# EasyEDA Pro project 立创·天猛星MSPM0G3507开发板.eprj, schematic Schematic

## Sheets
1 core: Board Name: V1.0.2; Create Date: 2025-05-24; Page Name: core; Project Name: 立创·天猛星MSPM0G3507开发板; Schematic Name: Schematic; Update Date: 2025-05-24; Company: 嘉立创EDA; Page Size: A4; Reviewed: 嘉立创EDA
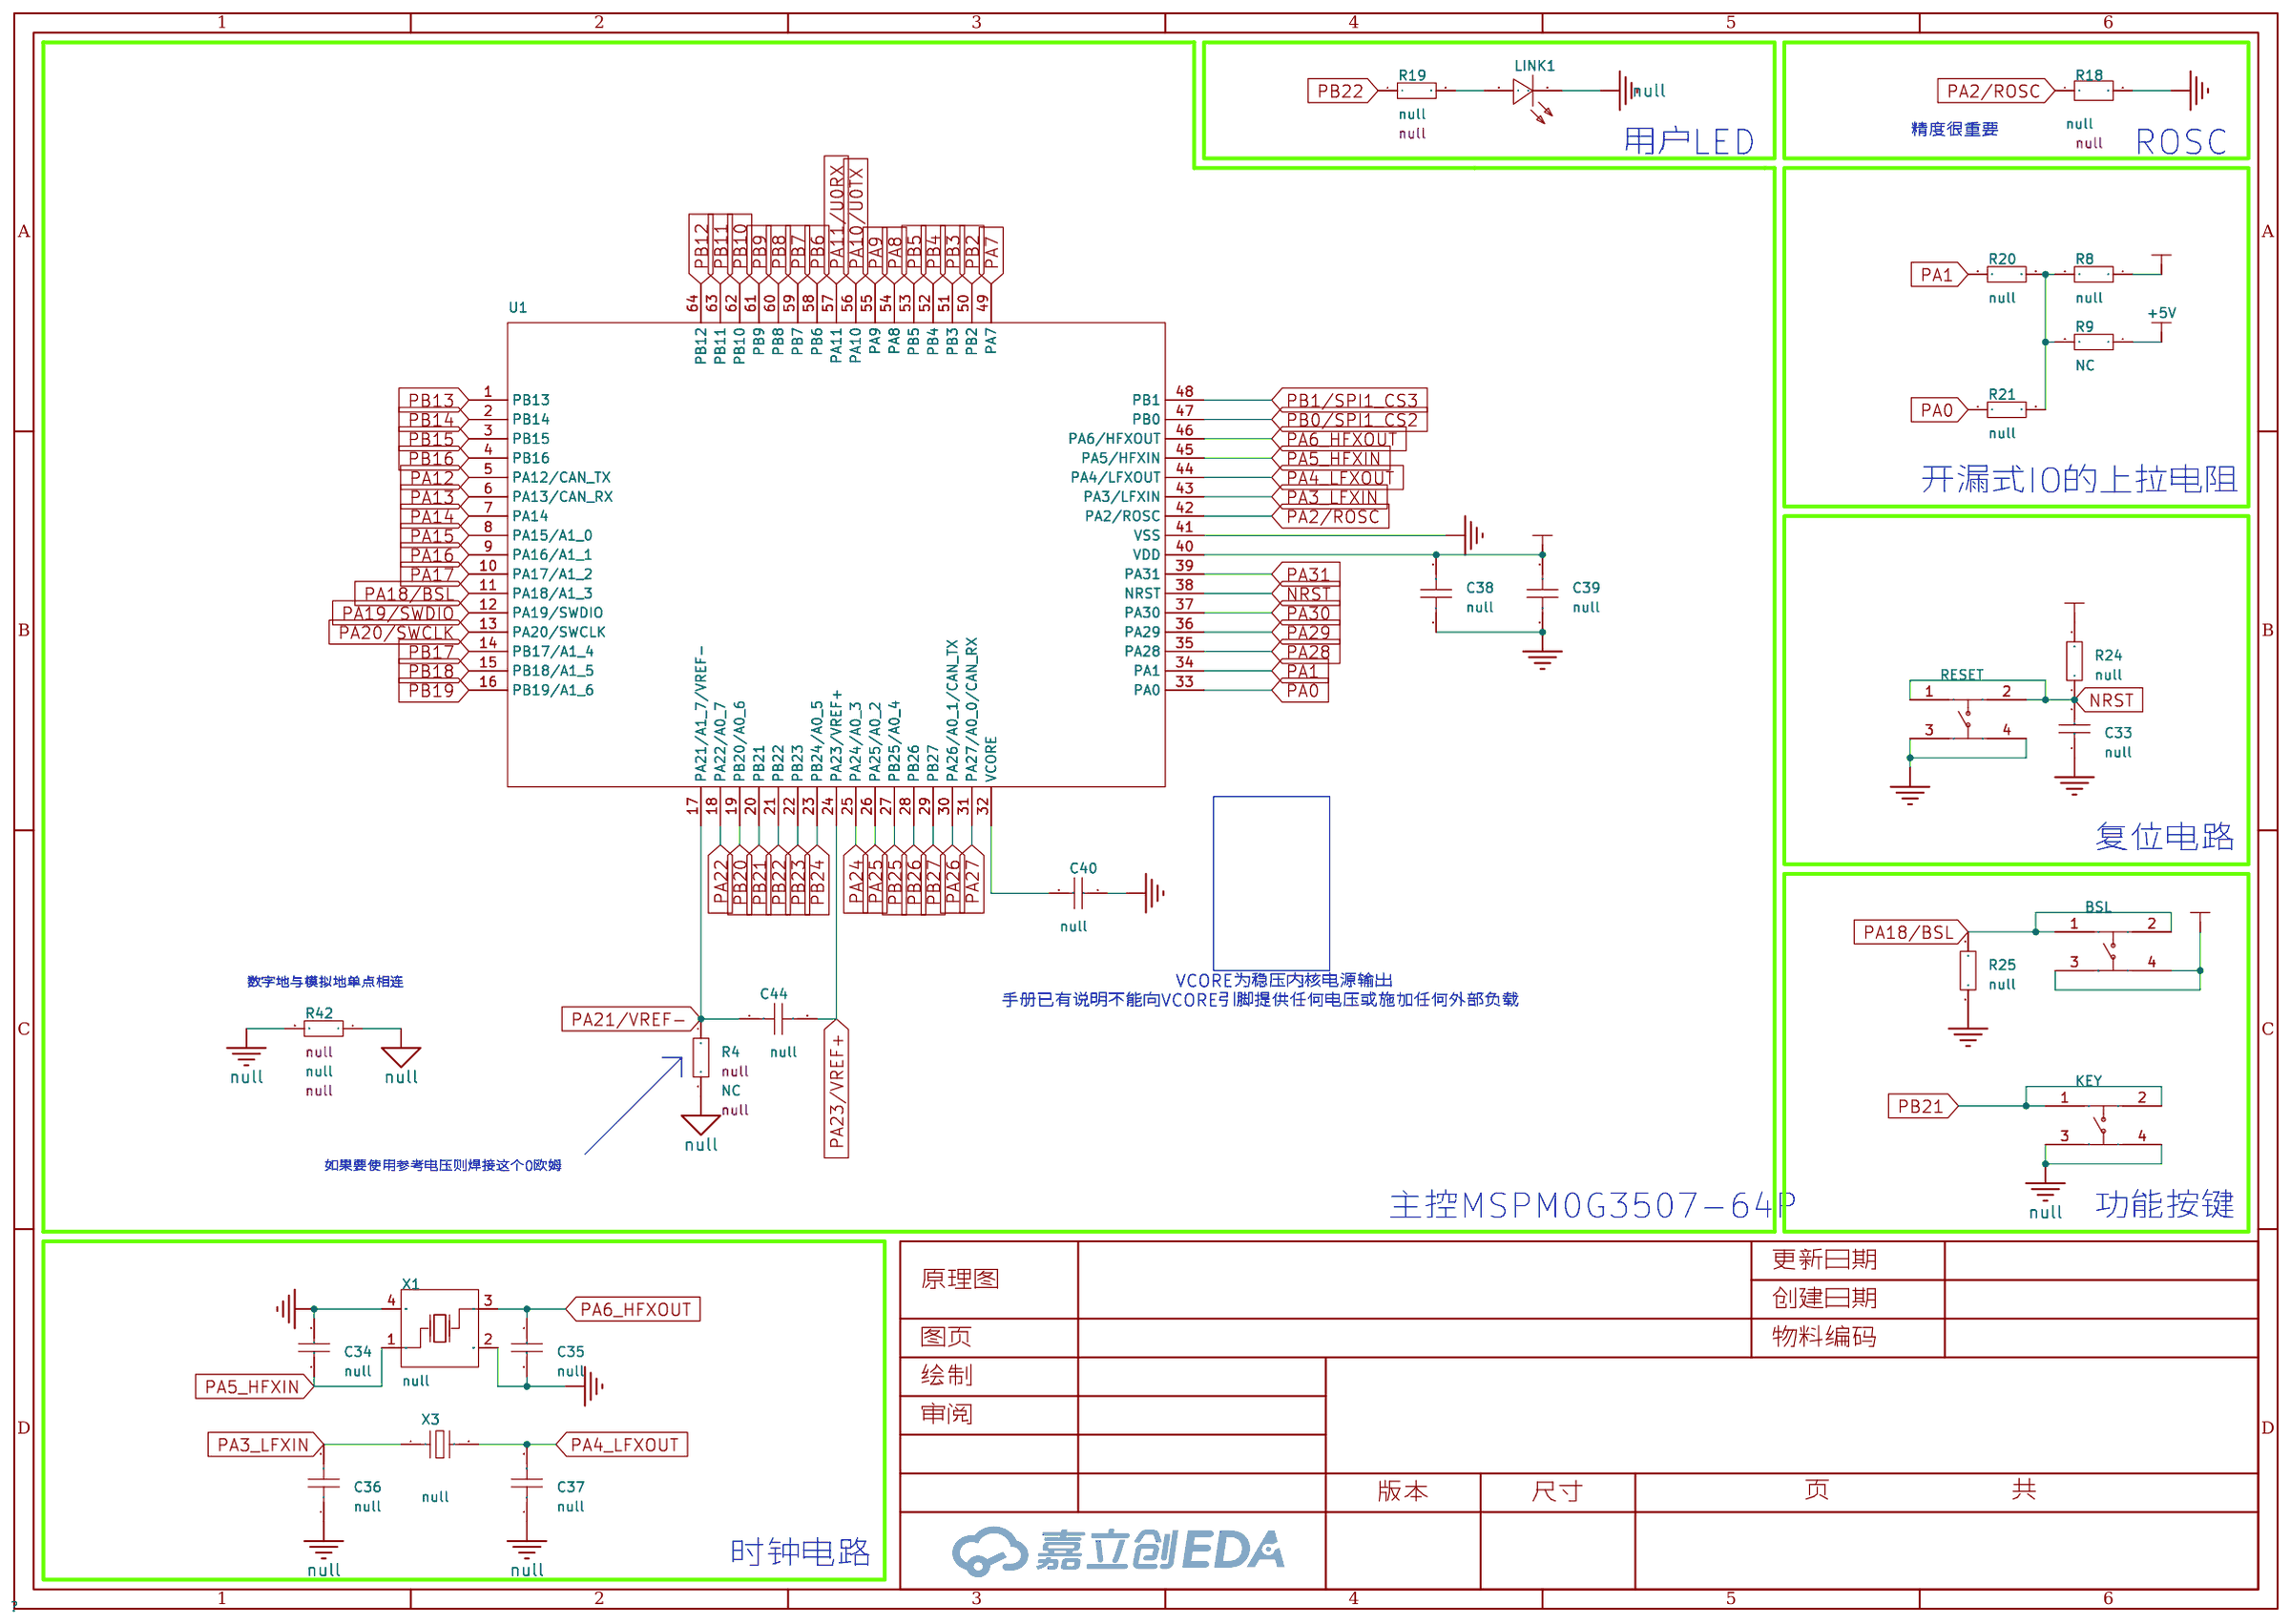
[diagram p0: core]
2 power: Create Date: 2024-11-14; Page Name: power; Update Date: 2024-11-14
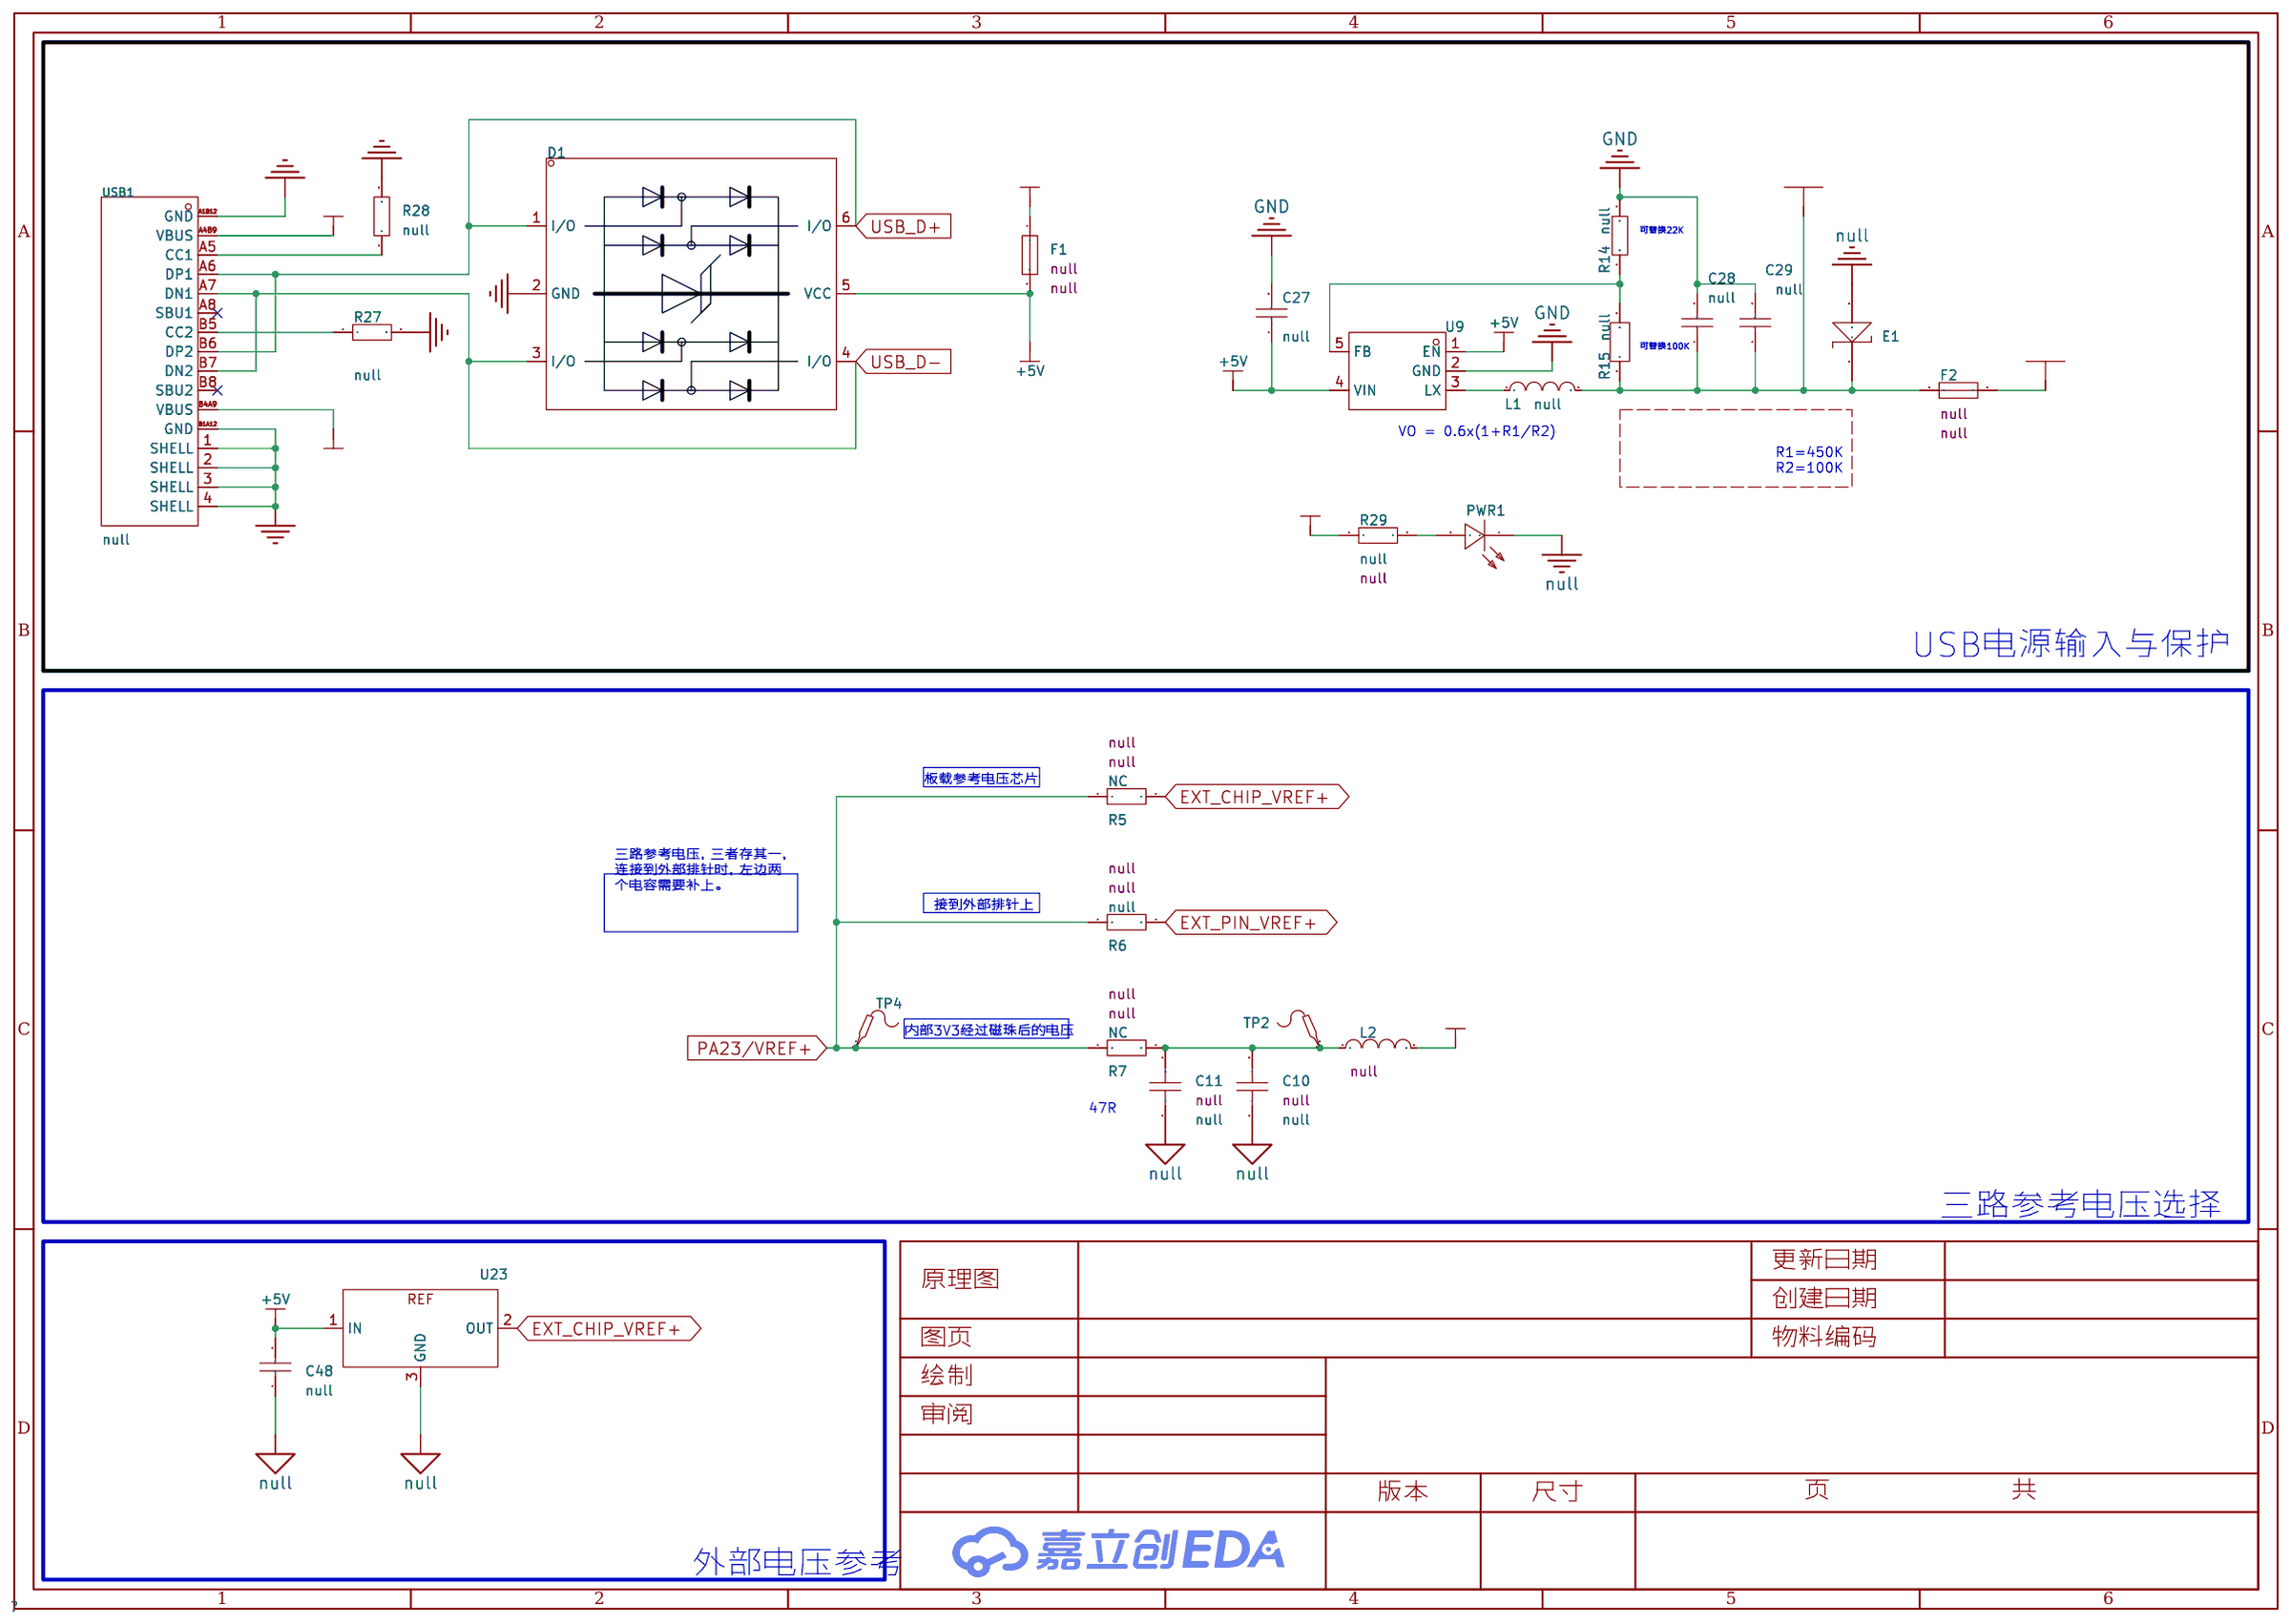
[diagram p1: power]
3 extension: Create Date: 2024-11-14; Page Name: extension; Update Date: 2024-11-14
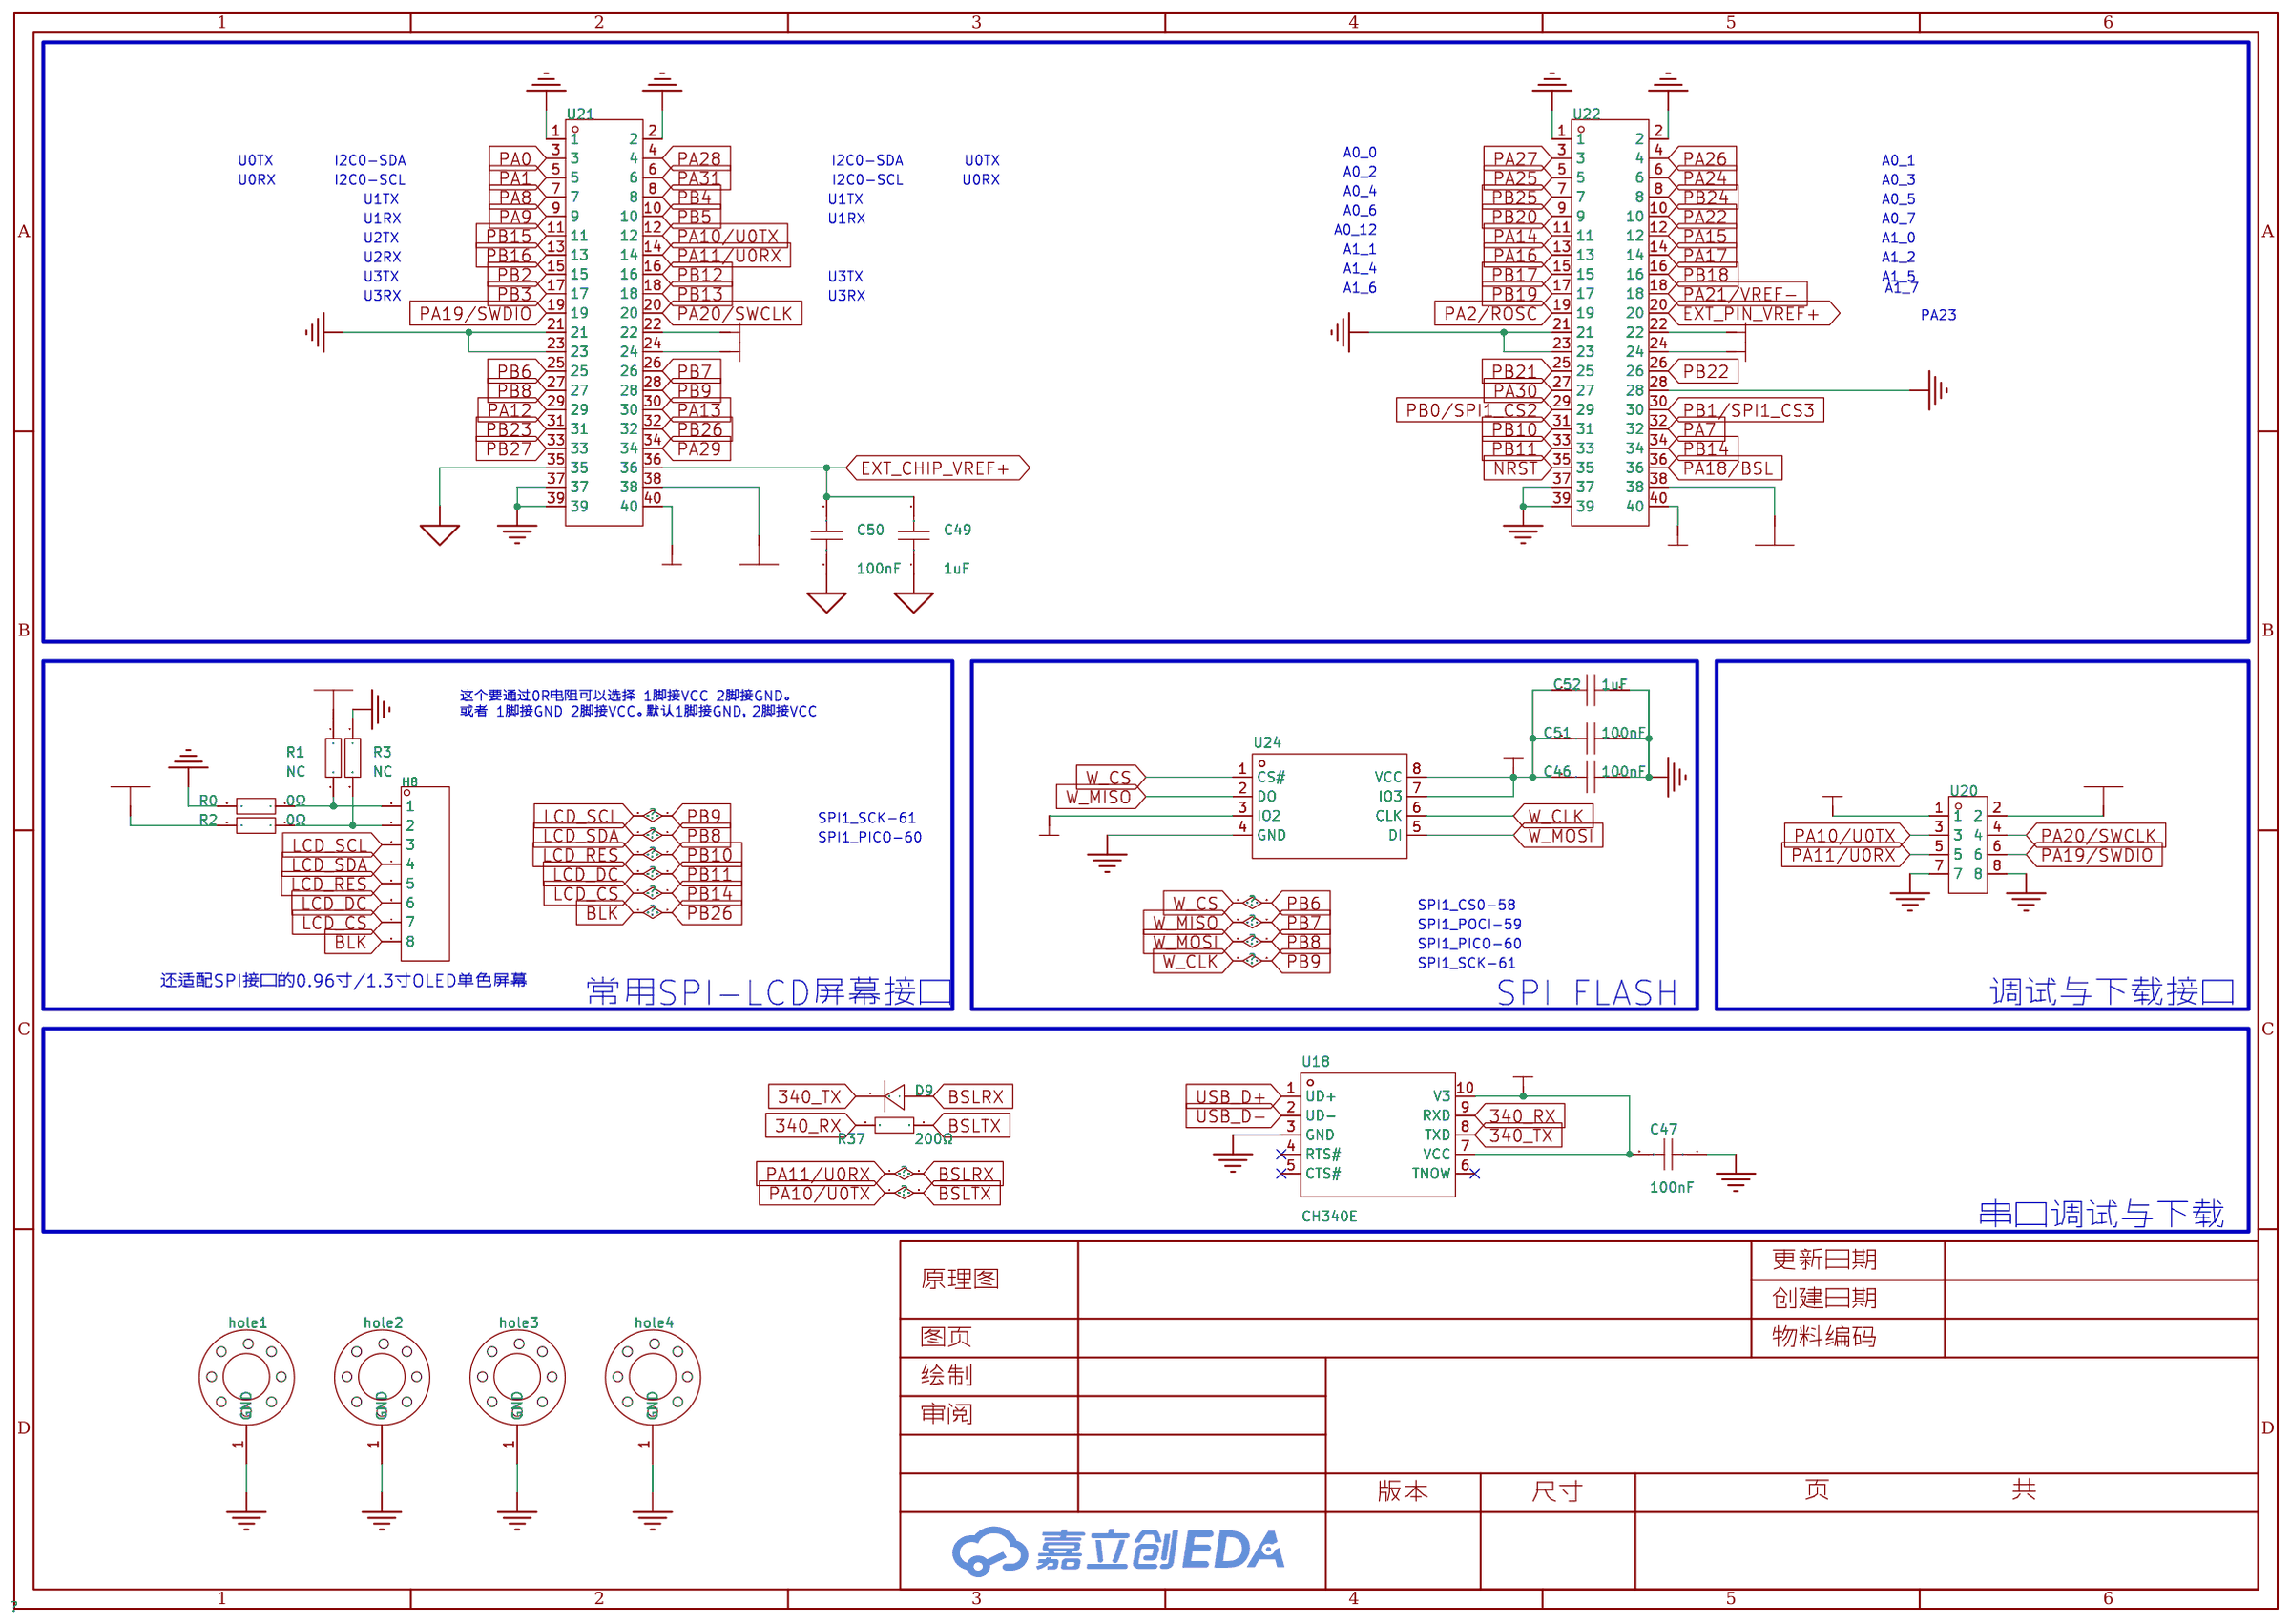
[diagram p2: extension]

## Parts
sheet core
BSL  null  [KEY-SMD_4P-L4.2-W3.2-P2.20-LS5.1-TL]
C33  null  [R0603]
C34  null  [R0402]
C35  null  [R0402]
C36  null  [R0402]
C37  null  [R0402]
C38  null  [R0402]
C39  null  [C0603]
C40  null  [R0402]
C44  null  [R0603]
KEY  null  [KEY-SMD_4P-L4.2-W3.2-P2.20-LS5.1-TL]
LINK1  NCD0603G1  [LED0603-RD]
R4  NC  [R0603]
R8  null  [R0603]
R9  NC  [R0603]
R18  null  [R0402]
R19  null  [R0603]
R20  null  [R0603]
R21  null  [R0603]
R24  null  [R0603]
R25  null  [R0603]
R42  null  [R0603]
RESET  null  [KEY-SMD_4P-L4.2-W3.2-P2.20-LS5.1-TL]
U1  -  [LQFP-64_L10.0-W10.0-P0.50-LS12.0-TL]
X1  40MHz  [OSC-SMD_4P-L3.2-W2.5-BL_SIT8008BI]
X3  null  [OSC-SMD_L3.2-W1.5]
sheet extension
C46  100nF  [R0603]
C47  100nF  [R0603]
C49  1uF  [R0603]
C50  100nF  [R0603]
C51  100nF  [R0603]
C52  1uF  [R0603]
D9  RB521S30T1G  [SOD-523_L1.2-W0.8-LS1.6-RD]
H8  -  [HDR-TH_8P-P2.54-V-M]
hole1  M3  [m3 125x300]
hole2  M3  [m3 125x300]
hole3  M3  [m3 125x300]
hole4  M3  [m3 125x300]
R0  0Ω  [R0603]
R1  NC  [R0603]
R2  0Ω  [R0603]
R3  NC  [R0603]
R37  200Ω  [R0603]
U18  CH340E  [MSOP-10_L3.0-W3.0-P0.50-LS5.0-BL]
U20  2541WV-2x04P  [HDR-TH_8P-P2.54-V-M-R2-C4-S2.54-3]
U21  PZ2.54-2*20  [HDR-TH_40P-P2.54-V-M-R2-C20-S2.54]
U22  PZ2.54-2*20  [HDR-TH_40P-P2.54-V-M-R2-C20-S2.54]
U24  W25Q128JVSIQ  [SOIC-8_L5.3-W5.3-P1.27-LS8.0-BL]
sheet power
C10  null  [R0603]
C11  null  [R0603]
C27  null  [R0603]
C28  null  [R0603]
C29  null  [R0603]
C48  null  [R0603]
D1  BST236A054U  [SOT-23-6_L2.9-W1.6-P0.95-LS2.8-BR]
E1  RLSD52A031V  [SOD-523F_L1.2-W0.8-LS1.7-RD]
F1  BSMD0603-050-6V  [F0603]
F2  BSMD0603-050-6V  [F0603]
L1  null  [ind-smd_l2.5-w2.0_tfm252012alma2r2mtaa]
L2  GZ1608D601TF  [L0603]
PWR1  NCD0603R1  [LED0603-RD_RED]
R5  NC  [R0603]
R6  null  [R0603]
R7  NC  [R0603]
R14  null  [R0603]
R15  null  [R0603]
R27  null  [R0603]
R28  null  [R0603]
R29  null  [R0603]
TP2  -  [Test-Point-1.27mm]
TP4  -  [Test-Point-1.27mm]
U9  -  [sot-23-5_l2.9-w1.6-p0.95-ls2.8-bl]
U23  null  [SOT-23-3_L3.0-W1.7-P0.95-LS2.9-BR]
USB1  null  [USB-C-SMD_TYPE-C16PIN]

## Library data of the parts